# EasyEDA Pro project wukong01-Y003-HTOL - 2.eprj, schematic Schematic1
Create Date: 2023-04-12; Page Name: P1; Project Name: wukong01-Y003-HTOL - 2; Schematic Name: Schematic1; Update Date: 2023-04-19; Company: 嘉立创EDA; Page Size: A4; Version: V1.0
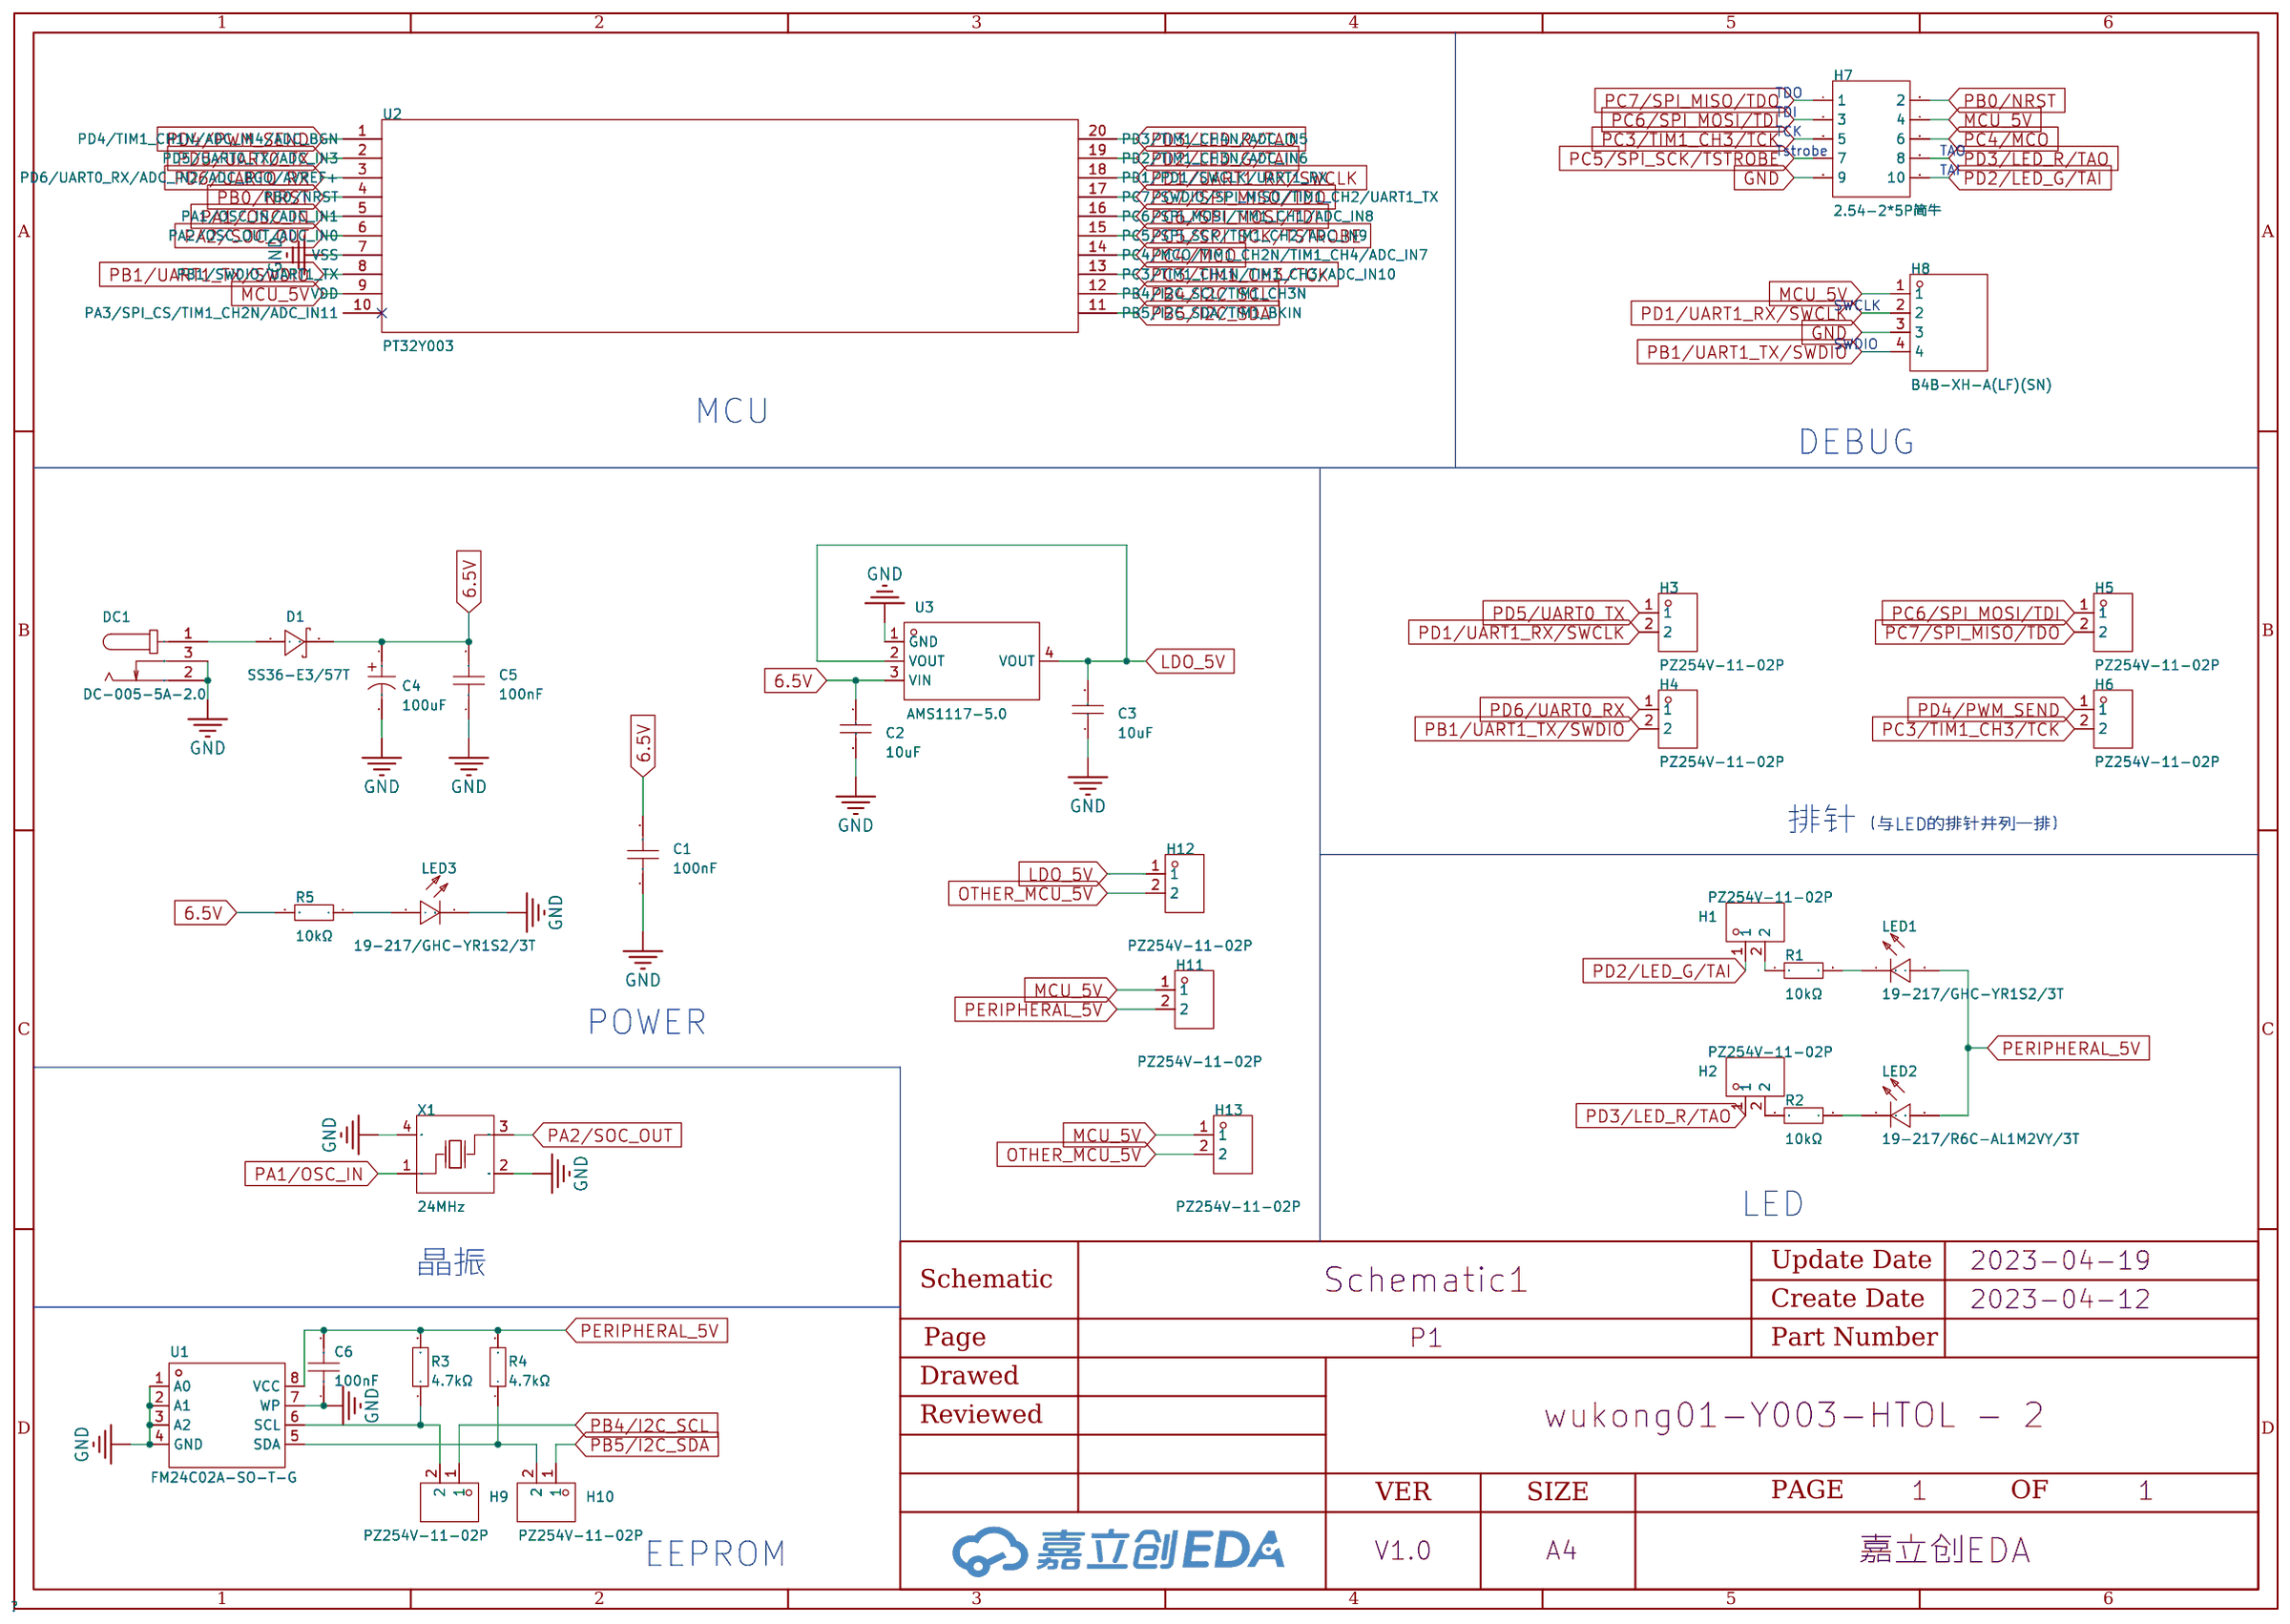
[diagram p0: schematic sheet]

## Parts
C1  100nF  [C0603]
C2  10uF  [C1206]
C3  10uF  [C1206]
C4  100uF  [CAP-SMD_BD6.3-L6.6-W6.6-LS7.6-FD-1]
C5  100nF  [C0603]
C6  100nF  [C0603]
D1  SS36-E3/57T  [SMC_L7.1-W6.2-LS8.1-R-RD]
DC1  DC-005-5A-2.0  [DC-IN-TH_DC-005-5A-2.0]
H1  PZ254V-11-02P  [HDR-TH_2P-P2.54-V-M]
H2  PZ254V-11-02P  [HDR-TH_2P-P2.54-V-M]
H3  PZ254V-11-02P  [HDR-TH_2P-P2.54-V-M]
H4  PZ254V-11-02P  [HDR-TH_2P-P2.54-V-M]
H5  PZ254V-11-02P  [HDR-TH_2P-P2.54-V-M]
H6  PZ254V-11-02P  [HDR-TH_2P-P2.54-V-M]
H7  2.54-2*5P简牛  [IDC-TH_10P-P2.54_C5665]
H8  B4B-XH-A(LF)(SN)  [CONN-TH_B4B-XH-A-LF-SN]
H9  PZ254V-11-02P  [HDR-TH_2P-P2.54-V-M]
H10  PZ254V-11-02P  [HDR-TH_2P-P2.54-V-M]
H11  PZ254V-11-02P  [HDR-TH_2P-P2.54-V-M]
H12  PZ254V-11-02P  [HDR-TH_2P-P2.54-V-M]
H13  PZ254V-11-02P  [HDR-TH_2P-P2.54-V-M]
LED1  19-217/GHC-YR1S2/3T  [LED0603-RD]
LED2  19-217/R6C-AL1M2VY/3T  [LED0603-R-RD]
LED3  19-217/GHC-YR1S2/3T  [LED0603-RD]
R1  10kΩ  [R0603]
R2  10kΩ  [R0603]
R3  4.7kΩ  [R0603]
R4  4.7kΩ  [R0603]
R5  10kΩ  [R0603]
U1  FM24C02A-SO-T-G  [SOP-8_L5.0-W4.0-P1.27-LS6.2-BL]
U2  PT32Y003  [TSSOP-20_L6.5-W4.4-P0.65-LS6.4-BL]
U3  AMS1117-5.0  [SOT-223_L6.5-W3.5-P2.30-LS7.0-BR]
X1  24MHz  [CRYSTAL-SMD_4P-L3.2-W2.5-BL]

## Library data of the parts
C1 C5 = CL10B104KB8NNNC: 容值:100nF;精度:±10%;额定电压:50V;材质(温度系数):X7R;; LCSC Part Name: 100nF ±10% 50V; Supplier Part: C1591; Manufacturer: SAMSUNG(三星); Supplier Footprint: 0603; JLCPCB Part Class: Extended Part; Datasheet: https://atta.szlcsc.com/upload/public/pdf/source/20160103/1457707680512.pdf; Supplier: LCSC; Tolerance: ±10%; Voltage Rated: 50V; Temperature Coefficient: X7R
C2 C3 = CL31A106KBHNNNE: 容值:10uF;精度:±10%;额定电压:50V;材质(温度系数):X5R;; LCSC Part Name: 10uF ±10% 50V; Supplier Part: C13585; Manufacturer: SAMSUNG(三星); Supplier Footprint: 1206; JLCPCB Part Class: Basic Part; Datasheet: https://atta.szlcsc.com/upload/public/pdf/source/20160103/1457707668742.pdf; Supplier: LCSC; Tolerance: ±10%; Voltage Rated: 50V; Temperature Coefficient: X5R
C4 = RVE100UF35V67RV0072: 容值:100uF;额定电压:35V;电容体直径:-;电容体长度:-;纹波电流:-;等效串联电阻:-;工作寿命:-;; LCSC Part Name: 100uF 35V; Supplier Part: C2836437; Manufacturer: KNSCHA(科尼盛); Supplier Footprint: SMD,6.3x7.7mm; JLCPCB Part Class: Extended Part; Datasheet: https://atta.szlcsc.com/upload/public/pdf/source/20220719/B52EB46F8A1558448ED03D8B4CB3C24F.pdf; Supplier: LCSC; Rated Voltage: 35V
C6 = CC0603KRX7R9BB104: 容值:100nF;精度:±10%;额定电压:50V;材质(温度系数):X7R;; LCSC Part Name: 100nF ±10% 50V; Supplier Part: C14663; Manufacturer: YAGEO(国巨); Supplier Footprint: 0603; JLCPCB Part Class: Basic Part; Datasheet: https://atta.szlcsc.com/upload/public/pdf/source/20180910/C282072_33301C7F631E79921B82A8DAC6BCC5B3.pdf; Supplier: LCSC; Tolerance: ±10%; Voltage Rated: 50V; Temperature Coefficient: X7R
D1 = SS36-E3/57T: 直流反向耐压（Vr）:60V;平均整流电流（Io）:3A;正向压降（Vf）:750mV @ 3A;; Supplier Part: C35722; Manufacturer: VISHAY(威世); Supplier Footprint: SMC(DO-214AB); JLCPCB Part Class: Basic Part; Datasheet: https://atta.szlcsc.com/upload/public/pdf/source/20151007/1457707426323.pdf; Supplier: LCSC
DC1 = DC-005-5A-2.0: 连接器类型:DC电源插座;触点内径:2mm;触点外径:6.2mm;额定电流:5A;额定电压:24V;触头材质:黄铜;工作温度范围:-20℃~+70℃;焊接温度(最大值):260℃;; LCSC Part Name: DC电源插座 内径:2mm 外径:6.2mm; Supplier Part: C381116; Manufacturer: XKB Connectivity(中国星坤); Supplier Footprint: 插件; JLCPCB Part Class: Extended Part; Datasheet: https://atta.szlcsc.com/upload/public/pdf/source/20211015/707A35F7AB6E89C57AAB641950105BB7.pdf; Supplier: LCSC; Connector Type: DC电源插座; Inside Contact Diameter: 2mm; Outside Contact Diameter: 6.2mm; Current Rating (Max): 5A; Voltage Rating (Max): 24V; Contact Material: 黄铜; Operating Temperature Range: -20℃~+70℃; Welding Temperature (Max): 260℃
H1-H6 H9-H13 = PZ254V-11-02P: 排数:单排;总PIN位数:2;间距:2.54mm;插针结构:1x2P;行距:-;安装类型:直插;圆针/方针:方针;额定电流:-;额定电压:-;配合针长度:6mm;塑高:2.5mm;端接针长度:3mm;触头材质:黄铜;触头镀层:-;工作温度范围:-40℃~+105℃;颜色:黑色;; LCSC Part Name: 2.54mm 1x2P 直插 方针; Supplier Part: C492401; Manufacturer: XFCN(兴飞); Supplier Footprint: 直插,P=2.54mm; JLCPCB Part Class: Extended Part; Datasheet: https://atta.szlcsc.com/upload/public/pdf/source/20200309/C492401_A812433581A9B211A7FFA413ADDFF0E5.pdf; Supplier: LCSC; Number of Rows: 单排; Number of Pins: 2; Pitch: 2.54mm; Pin Structure: 1x2P; Mounting Type: 直插; Circluar Pins/Square Pins: 方针; Length of Mating Pin: 6mm; Insulation Height: 2.5mm; Length of End Connection Pin: 3mm; Contact Material: 黄铜; Operating Temperature Range: -40℃~+105℃; Color: 黑色
H7 = 2.54-2*5P简牛: 连接器类型:简牛座;每排PIN数:5;排数:2;间距:2.54mm;行距:2.54mm;封装形式:直插;触头材质:-;触头镀层:-;; LCSC Part Name: 每排P数:5 排数:2 2.54mm; Supplier Part: C5665; Manufacturer: BOOMELE(博穆精密); Supplier Footprint: 插件,P=2.54mm; JLCPCB Part Class: Extended Part; Datasheet: https://atta.szlcsc.com/upload/public/pdf/source/20140331/1457707037896.pdf; Supplier: LCSC; Connector Type: 简牛座; Pin Number in each Row: 5; Number of Rows: 2; Pitch: 2.54mm; Row Spacing: 2.54mm; Holder Type: 直插
H8 = B4B-XH-A(LF)(SN): 参考系列:XH;间距:2.5mm;插针结构:1x4P;排数:1;每排PIN数:4;行距:-;安装方式:-;触头材质:黄铜;; LCSC Part Name: XH 2.5mm 1x4P; Supplier Part: C144395; Manufacturer: JST; Supplier Footprint: 插件,P=2.5mm; JLCPCB Part Class: Extended Part; Datasheet: https://atta.szlcsc.com/upload/public/pdf/source/20180327/C144395_D58F0D17A3F58B29FECD1B7D0A791262.pdf; Supplier: LCSC; Reference Series: XH; Pitch: 2.5mm; Pins Structure: 1x4P; Number of Rows: 1; Number of PINs Per Row: 4; Contact Material: 黄铜
LED1 LED3 = 19-217/GHC-YR1S2/3T: 发光颜色:翠绿;二极管配置:-;透镜颜色:无色透明;主波长:520nm~535nm;峰值波长:518nm;色温:-;测试电流:20mA;功率:110mW;发光角度:120°;安装方式:-;工作温度:-40℃~+85℃;; LCSC Part Name: 翠绿 520nm~535nm; Supplier Part: C72043; Manufacturer: EVERLIGHT(亿光); Supplier Footprint: 0603; JLCPCB Part Class: Basic Part; Datasheet: https://atta.szlcsc.com/upload/public/pdf/source/20160507/1462613613780.pdf; Supplier: LCSC; Emitted Color: 翠绿; Lens Color: 无色透明; Dominant Wavelength: 520nm~535nm; Peak Wavelength: 518nm; Forward Current: 20mA; Power Dissipation: 110mW; Viewing Angle: 120°; Operating Temperature: -40℃~+85℃
LED2 = 19-217/R6C-AL1M2VY/3T: 发光颜色:红灯;二极管配置:-;透镜颜色:无色透明;主波长:617.5nm;峰值波长:632nm;色温:-;光通量(25℃时):-;测试电流:5mA;正向电压(VF):2.2V;发光强度:28.5mcd;功率:60mW;发光角度:120°;安装方式:-;工作温度:-40℃~+85℃;; LCSC Part Name: 0603 红灯; Supplier Part: C72044; Manufacturer: EVERLIGHT(台湾亿光); Supplier Footprint: 0603; JLCPCB Part Class: Extended Part; Datasheet: https://atta.szlcsc.com/upload/public/pdf/source/20160507/1462613613821.pdf; Supplier: LCSC; Emitted Color: 红灯; Lens Color: 无色透明; Dominant Wavelength: 617.5nm; Peak Wavelength: 632nm; Forward Current: 5mA; Forward Voltage (VF): 2.2V; Luminous Intensity: 28.5mcd; Power Dissipation: 60mW; Viewing Angle: 120°; Operating Temperature: -40℃~+85℃
R1 R2 = 0603WAF1002T5E: 电阻类型:厚膜电阻;阻值:10kΩ;精度:±1%;功率:100mW;; LCSC Part Name: 10kΩ ±1% 100mW; Supplier Part: C25804; Manufacturer: UNI-ROYAL(厚声); Supplier Footprint: 0603; JLCPCB Part Class: Basic Part; Datasheet: https://atta.szlcsc.com/upload/public/pdf/source/20200306/C422600_1E6D84923E4A46A82E41ADD87F860B5C.pdf; Supplier: LCSC; Type: 厚膜电阻; Tolerance: ±1%; Power(Watts): 100mW; Temperature Coefficient: ±100ppm/℃; Overload Voltage (Max): 75V; Operating Temperature Range: -55℃~+155℃
R3 R4 = 0603WAF4701T5E: 电阻类型:厚膜电阻;阻值:4.7kΩ;精度:±1%;功率:100mW;; LCSC Part Name: 4.7kΩ ±1% 100mW; Supplier Part: C23162; Manufacturer: UNI-ROYAL(厚声); Supplier Footprint: 0603; JLCPCB Part Class: Basic Part; Datasheet: https://atta.szlcsc.com/upload/public/pdf/source/20200306/C422600_1E6D84923E4A46A82E41ADD87F860B5C.pdf; Supplier: LCSC; Type: 厚膜电阻; Tolerance: ±1%; Power(Watts): 100mW; Temperature Coefficient: ±100ppm/℃; Overload Voltage (Max): 75V; Operating Temperature Range: -55℃~+155℃
R5 = 0603WAF1002T5E: 电阻类型:厚膜电阻;阻值:10kΩ;精度:±1%;功率:100mW;温度系数:±100ppm/℃;最大工作电压:75V;工作温度范围:-55℃~+155℃;; LCSC Part Name: 10kΩ ±1% 100mW; Supplier Part: C25804; Manufacturer: UNI-ROYAL(厚声); Supplier Footprint: 0603; JLCPCB Part Class: Basic Part; Datasheet: https://atta.szlcsc.com/upload/public/pdf/source/20200306/C422600_1E6D84923E4A46A82E41ADD87F860B5C.pdf; Supplier: LCSC; Type: 厚膜电阻; Tolerance: ±1%; Power(Watts): 100mW; Temperature Coefficient: ±100ppm/℃; Overload Voltage (Max): 75V; Operating Temperature Range: -55℃~+155℃
U1 = FM24C02A-SO-T-G: 存储器接口类型:I2C;存储器容量:2Kb (256 x 8);工作电压:1.7V ~ 5.5V;; Supplier Part: C9997; Manufacturer: FM(复旦微); Supplier Footprint: SOP-8_150mil; JLCPCB Part Class: Extended Part; Datasheet: https://atta.szlcsc.com/upload/public/pdf/source/20140226/1457706994856.pdf; Supplier: LCSC; Memory Format: EEPROM; Memory Interface: I2C; Memory Size: 2Kb (256 x 8); Voltage - Supply: 1.7V ~ 5.5V
U2 = PT32Y003
U3 = AMS1117-5.0_C6187: 输出类型:固定;输出极性:正;输出通道数:1;最大输入电压:15V;输出电压:5V;压差:1.3V@(1A);输出电流:1A;电源纹波抑制比(PSRR):68dB@(120Hz);; LCSC Part Name: 正 Vin=15V Vout=5V 1A 68dB@(120Hz); Supplier Part: C6187; Manufacturer: AMS; Supplier Footprint: SOT-223; JLCPCB Part Class: Basic Part; Datasheet: https://atta.szlcsc.com/upload/public/pdf/source/20180727/C6186_7A095716F0823C02F1997A905E26C086.pdf; Supplier: LCSC; Output Type: 固定; Output Polarity: 正; Number of Outputs: 1; Maximum Input Voltage: 15V; Output Voltage: 5V; Dropout Voltage: 1.3V@(1A); Output Current: 1A; Power Supply Rejection Ratio (PSRR): 68dB@(120Hz)
X1 = 3S24000333: 频率:24MHz;频率公差:±10ppm;频率稳定度:±50ppm;负载电容:8pF;; LCSC Part Name: 24MHz ±10ppm 8pF; Supplier Part: C427553; Manufacturer: YL(惠伦晶体); Supplier Footprint: SMD3225-4P; JLCPCB Part Class: Extended Part; Datasheet: https://atta.szlcsc.com/upload/public/pdf/source/20190911/C427553_A09B0D9076107BB8EFDFC7C7D2192982.pdf; Supplier: LCSC; Crystal Type: 贴片无源晶振; Frequency Tolerance: ±10ppm; Frequency Stability: ±50ppm; Load Capacitance: 8pF; Equivalent Series Resistance (ESR): 50Ω; Operating Temperature: -40℃~+125℃

## Nets
6.5V: C1.2 C2.1 C4.1 C5.2 D1.2(K) R5.2 U3.3(VIN)
GND: C1.1 C2.2 C3.1 C4.2 C5.1 C6.1 DC1.2 DC1.3 H7.9 H8.3 LED3.1(C) U1.1(A0) U1.2(A1) U1.3(A2) U1.4(GND) U1.7(WP) U2.7(VSS) U3.1(GND) X1.2(GND) X1.4(GND)
LDO_5V: C3.2 H12.1 U3.2(VOUT) U3.4(VOUT)
MCU_5V: H7.4 H8.1 H11.1 H13.1 U2.9(VDD)
OTHER_MCU_5V: H12.2 H13.2
PA1/OSC_IN: U2.5(PA1/OSC_IN/ADC_IN1) X1.1(OSC1)
PA2/SOC_OUT: U2.6(PA2/OSC_OUT/ADC_IN0) X1.3(OSC2)
PB0/NRST: H7.2 U2.4(PB0/NRST)
PB1/UART1_TX/SWDIO: H4.2 H8.4 U2.8(PB1/SWDIO/UART1_TX)
PB4/I2C_SCL: H9.1 U2.12(PB4/I2C_SCL/TIM1_CH3N)
PB5/I2C_SDA: H10.1 U2.11(PB5/I2C_SDA/TIM1_BKIN)
PC3/TIM1_CH3/TCK: H6.2 H7.5 U2.13(PC3/TIM1_CH1N/TIM1_CH3/ADC_IN10)
PC4/MCO: H7.6 U2.14(PC4/MCO/TIM1_CH2N/TIM1_CH4/ADC_IN7)
PC5/SPI_SCK/TSTROBE: H7.7 U2.15(PC5/SPI_SCK/TIM1_CH2/ADC_IN9)
PC6/SPI_MOSI/TDI: H5.1 H7.3 U2.16(PC6/SPI_MOSI/TIM1_CH1/ADC_IN8)
PC7/SPI_MISO/TDO: H5.2 H7.1 U2.17(PC7/SWDIO/SPI_MISO/TIM1_CH2/UART1_TX)
PD1/UART1_RX/SWCLK: H3.2 H8.2 U2.18(PD1/PD1/SWCLK/UART1_RX)
PD2/LED_G/TAI: H1.1 H7.10 U2.19(PD2/TIM1_CH3N/ADC_IN6)
PD3/LED_R/TAO: H2.1 H7.8 U2.20(PD3/TIM1_CH4N/ADC_IN5)
PD4/PWM_SEND: H6.1 U2.1(PD4/TIM1_CH1N/ADC_IN4/ADC_BGN)
PD5/UART0_TX: H3.1 U2.2(PD5/UART0_TX/ADC_IN3)
PD6/UART0_RX: H4.1 U2.3(PD6/UART0_RX/ADC_IN2/ADC_BGO/AVREF+)
PERIPHERAL_5V: C6.2 H11.2 LED1.2(A) LED2.1(A) R3.2 R4.2 U1.8(VCC)
$1N849: LED1.1(C) R1.2
$1N852: LED2.2(C) R2.2
$1N3085: H1.2 R1.1
$1N3176: H2.2 R2.1
$1N6085: LED3.2(A) R5.1
$1N6296: D1.1(A) DC1.1
$1N15873: H10.2 R4.1 U1.5(SDA)
$1N15897: H9.2 R3.1 U1.6(SCL)

Not connected (* = marked no-connect by the designer): U2 10(PA3/SPI_CS/TIM1_CH2N/ADC_IN11)*

## Notes on the sheet
- TDO
- TDI
- TCK
- Tstrobe
- TAO
- TAI
- SWCLK
- SWDIO
- MCU
- DEBUG
- 排针
- （与LED的排针并列一排）
- POWER
- LED
- 晶振
- EEPROM
